# Altium schematic sheet SysUprTestUUUp.SchDoc (part 2 of 2)
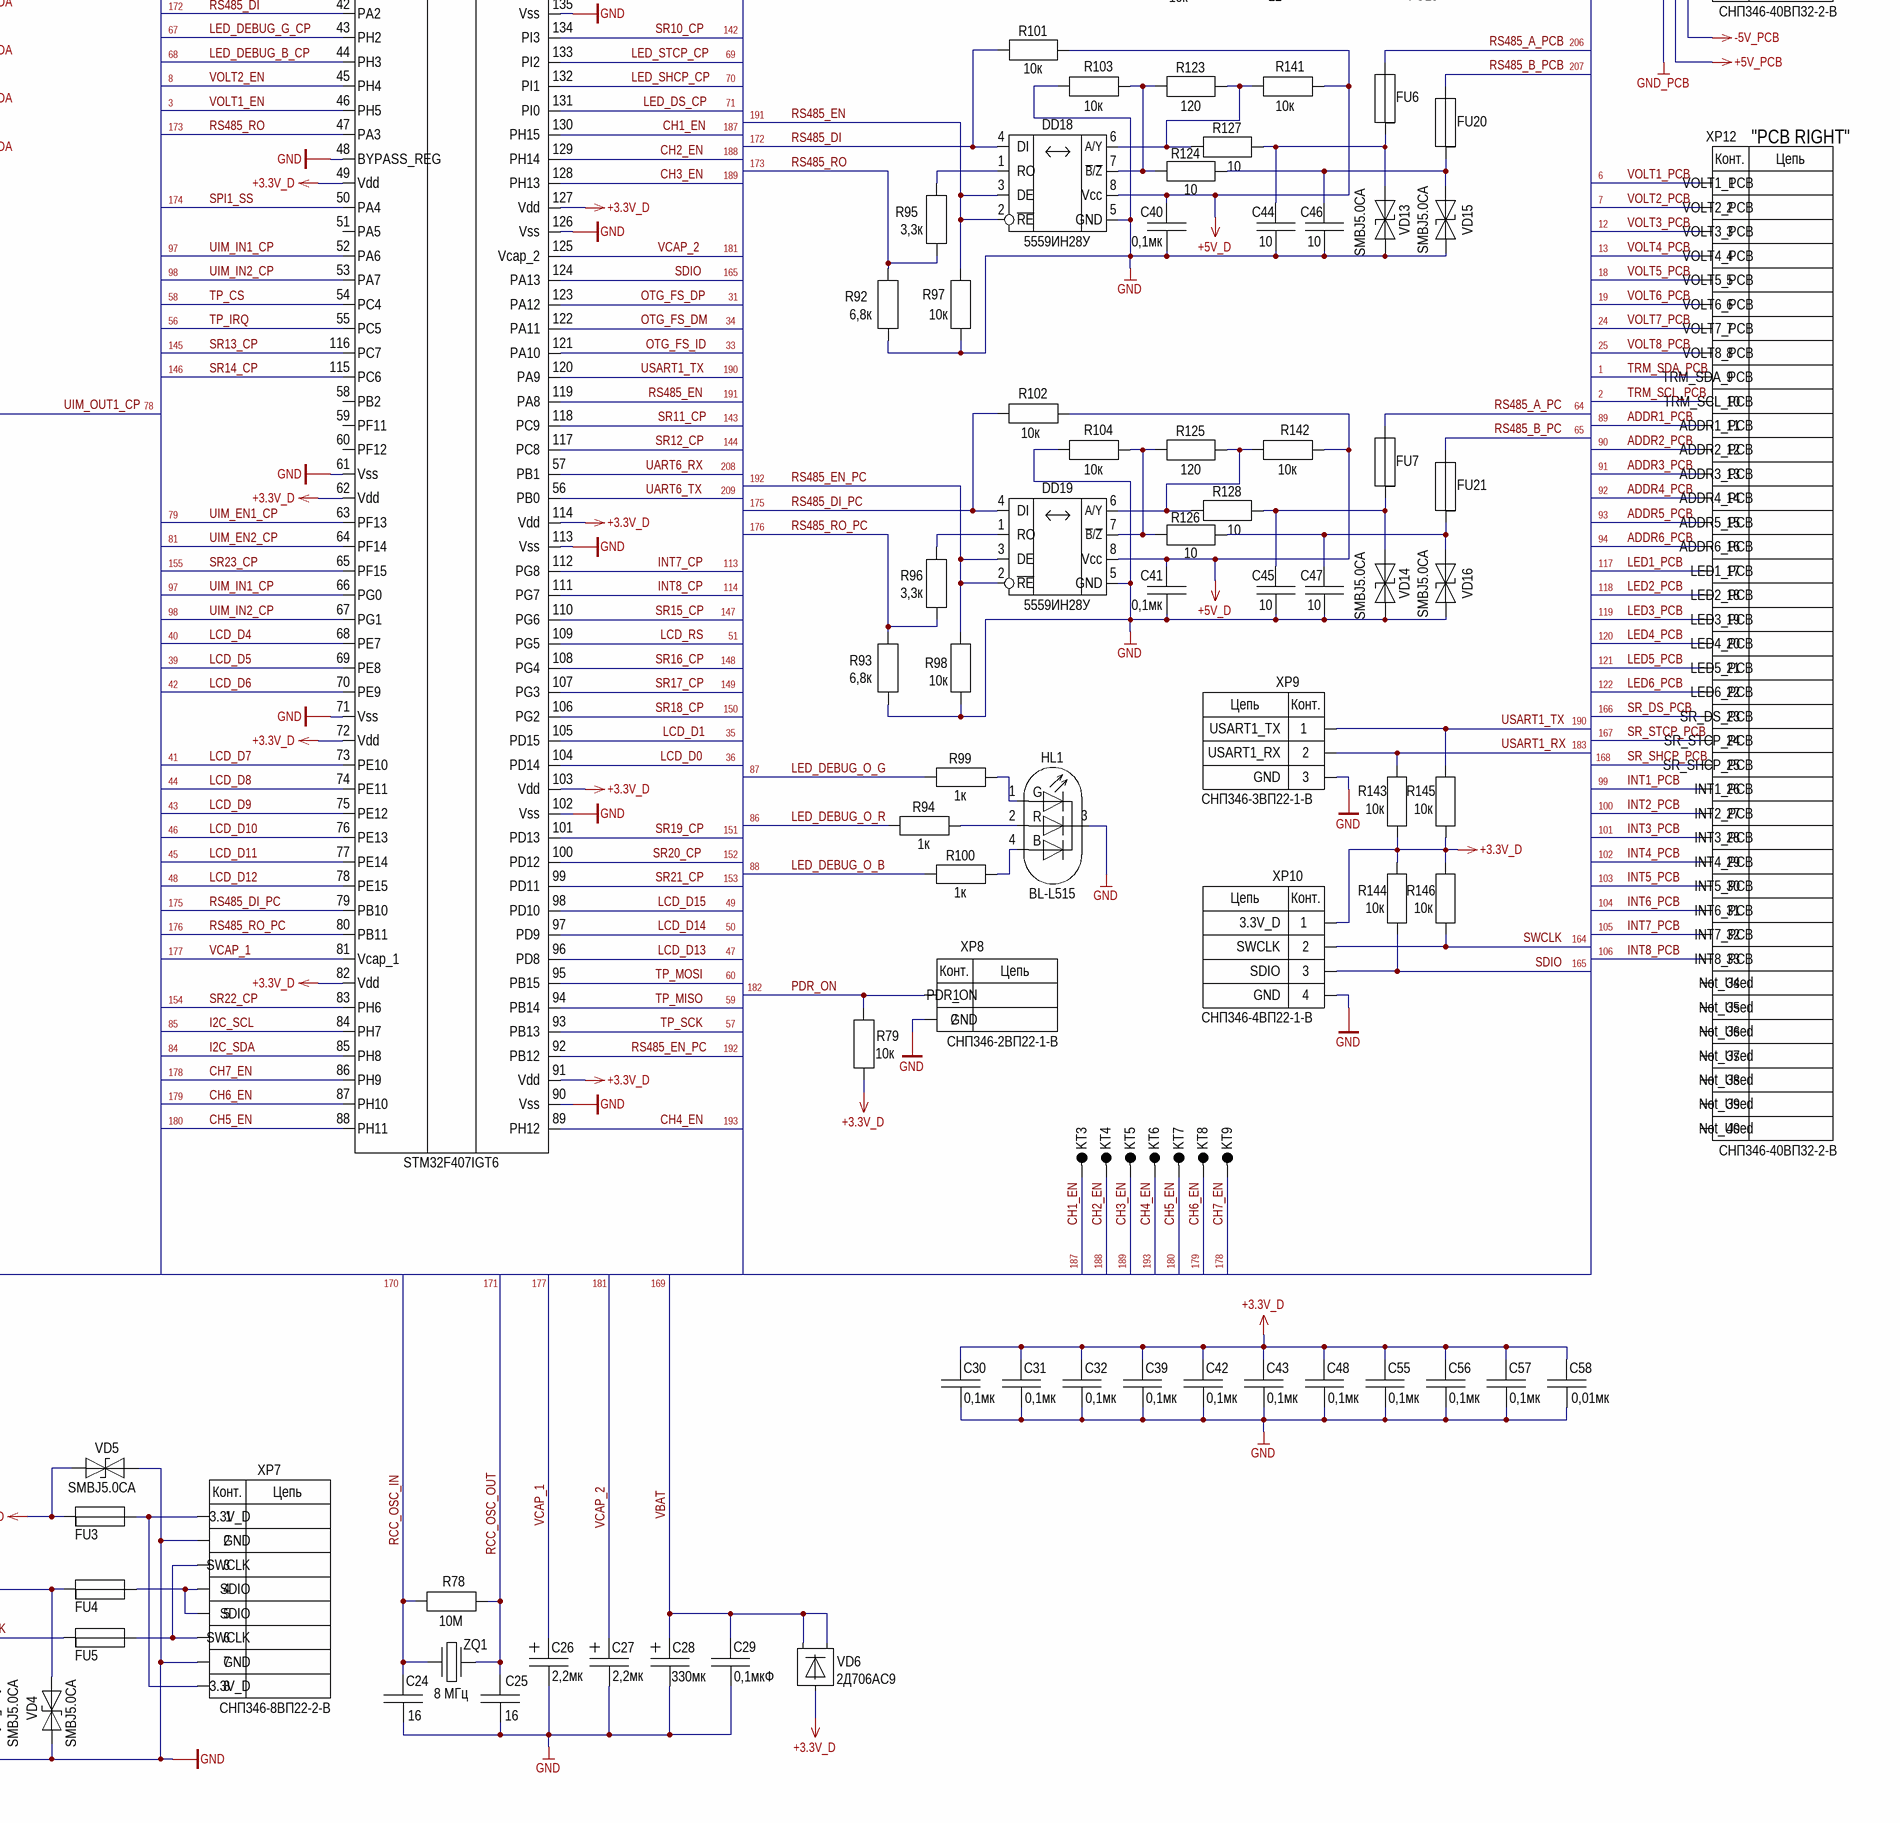
[diagram p4: SysUprTestUUUp.SchDoc, bottom right]

## Library data of the parts
C1 C2 C7 C8 C15 C29 = 2161: PartNumber: К10-84в-2012М-50 В-Н90-0,1 мкФ+80 %-20 %-N-A; Manufacturer: ОАО «ВЗРД Монолит»; ManufacturerTU: ФЦТА.673516.016ТУ; Alternative: 0805 0,1 мкФ, 50 В, ±10 %; Name: К10-84в; Group: Конденсаторы; ViewControl: В, 10%; SolderName: K10-84v-2012M-50V-N90-0,1mkF; X_SORT_1: 100; X_SORT_2: 200; X_SORT_3: 4; SolderTemperature: 175; TemperatureRange: от минус 60 до 85; CardKRR: 67; VoltageLimit: 50; Key: 2161; MilitaryControl: ВП; MountType: ПМ; Modify: 13.03.2019; Package: 0805 (2012); ComponentLink1Description: К10-84; ComponentLink1URL: \\192.168.0.253\U_Base\PDF\C\K10-84.pdf; HelpURL: \\192.168.0.253\U_Base\PDF\C\K10-84.pdf; DataSheet: #\\192.168.0.253\U_Base\PDF\C\K10-84.pdf#
C3 C4 C9 C11 C13 C16 C18 C20 C22 = 2164: PartNumber: К53-56А-16 В-4,7 мкФ±20 %; Manufacturer: АО «НИИ ГИРИКОНД»; ManufacturerTU: АЖЯР.673546.001ТУ; Alternative: Case B 4,7 мкФ, 16 В, ±20 %; Alternative2: К53-56А-16 В-4,7 мкФ±20 % В АДПК.673546.005ТУ; Name: К53-56А; Group: Конденсаторы; ViewControl: В, 10%; SolderName: K53-56A-16V-4.7mkF; X_SORT_1: 100; X_SORT_2: 200; X_SORT_3: 4; SolderTemperature: 265; TemperatureRange: от минус 60 до 125; CardKRR: 67; VoltageLimit: 16; Key: 2164; MilitaryControl: ВП; MountType: ПМ; Modify: 13.03.2019; Package: K2 (Case B); ComponentLink1Description: К53-56А; ComponentLink1URL: \\192.168.0.253\U_Base\PDF\C\K53-56.pdf; HelpURL: \\192.168.0.253\U_Base\PDF\C\K53-56.pdf; DataSheet: #\\192.168.0.253\U_Base\PDF\C\К53-56А.pdf#
C5 C6 C10 C12 C14 C17 C19 C21 C23 C30-C43 C48 C55-C57 = 2161: PartNumber: К10-84в-2012М-50 В-Н90-0,1 мкФ+80 %-20 %-N-A; Manufacturer: ОАО «ВЗРД Монолит»; ManufacturerTU: ФЦТА.673516.016ТУ; Alternative: 0805 0,1 мкФ, 50 В, ±10 %; Name: К10-84в; Group: Конденсаторы; ViewControl: В, 10%; SolderName: K10-84v-2012M-50V-N90-0,1mkF; X_SORT_1: 100; X_SORT_2: 200; X_SORT_3: 4; SolderTemperature: 175; TemperatureRange: от минус 60 до 85; CardKRR: 67; Key: 2161; VoltageLimit: 50; MilitaryControl: ВП; MountType: ПМ; Modify: 13.03.2019; Package: 0805 (2012); ComponentLink1Description: К10-84; ComponentLink1URL: \\192.168.0.253\U_Base\PDF\C\K10-84.pdf; HelpURL: \\192.168.0.253\U_Base\PDF\C\K10-84.pdf; DataSheet: #\\192.168.0.253\U_Base\PDF\C\K10-84.pdf#
C24 C25 = 2141: PartNumber: К10-84в-2012М-100 В-МП0-16 пФ±10 %-N-A; Manufacturer: ОАО «ВЗРД Монолит»; ManufacturerTU: ФЦТА.673516.016ТУ; Alternative: 0805 16 пФ, 100 В, ±10 %; Name: К10-84в; Group: Конденсаторы; ViewControl: В, 10%; SolderName: K10-84v-2012M-100V-MP0-16pF; X_SORT_1: 100; X_SORT_2: 200; X_SORT_3: 4; SolderTemperature: 175; TemperatureRange: от минус 60 до 85; CardKRR: 67; Key: 2141; MilitaryControl: ВП; MountType: ПМ; Modify: 13.03.2019; Package: 0805 (2012); ComponentLink1Description: К10-84; ComponentLink1URL: \\192.168.0.253\U_Base\PDF\C\K10-84.pdf; HelpURL: \\192.168.0.253\U_Base\PDF\C\K10-84.pdf; DataSheet: #\\192.168.0.253\U_Base\PDF\C\K10-84.pdf#; VoltageLimit: 100
C26 C27 = 2166: PartNumber: К53-56А-25 В-2,2 мкФ±20 %; Manufacturer: АО «НИИ ГИРИКОНД»; ManufacturerTU: АЖЯР.673546.001ТУ; Alternative: Case B 2,2 мкФ, 25 В, ±20 %; Alternative2: К53-56А-25 В-2,2 мкФ±20 % В АДПК.673546.005ТУ; Name: К53-56А; Group: Конденсаторы; ViewControl: В, 10%; SolderName: K53-56A-25V-2.2mkF; X_SORT_1: 100; X_SORT_2: 200; X_SORT_3: 4; SolderTemperature: 265; TemperatureRange: от минус 60 до 125; CardKRR: 67; VoltageLimit: 25; Key: 2166; MilitaryControl: ВП; MountType: ПМ; Modify: 13.03.2019; Package: K2 (Case B); ComponentLink1Description: К53-56А; ComponentLink1URL: \\192.168.0.253\U_Base\PDF\C\K53-56.pdf; HelpURL: \\192.168.0.253\U_Base\PDF\C\K53-56.pdf; DataSheet: #\\192.168.0.253\U_Base\PDF\C\К53-56А.pdf#
C28 = 2249: PartNumber: К53-67-10 В-330 мкФ±10 %; Manufacturer: АО «НИИ ГИРИКОНД»; ManufacturerTU: АЖЯР.673546.006ТУ; Alternative: Case D 330 мкФ, 10 В, ±10 %; Name: К53-67; Group: Конденсаторы; ViewControl: В, 10%; SolderName: K53-67-10V-330mkF; X_SORT_1: 100; X_SORT_2: 200; X_SORT_3: 4; SolderTemperature: 265; TemperatureRange: от минус 60 до 125; CardKRR: 67; VoltageLimit: 32; Key: 2249; MilitaryControl: ВП; MountType: ПМ; Modify: 13.03.2019; Package: K3 (Case D); ComponentLink1Description: К53-67
C44-C47 C49-C54 = 2111: PartNumber: К10-84в-1608М-100 В-МП0-10 пФ±10 %-N-A; Manufacturer: ОАО «ВЗРД Монолит»; ManufacturerTU: ФЦТА.673516.016ТУ; Alternative: 0603 10 пФ, 100 В, ±10 %; Name: К10-84в; Group: Конденсаторы; ViewControl: В, 10%; SolderName: K10-84v-1608M-100V-MP0-10pF; X_SORT_1: 100; X_SORT_2: 200; X_SORT_3: 4; SolderTemperature: 175; TemperatureRange: от минус 60 до 85; CardKRR: 67; Key: 2111; MilitaryControl: ВП; MountType: ПМ; Modify: 13.03.2019; Package: 0603 (1608); ComponentLink1Description: К10-84; ComponentLink1URL: \\192.168.0.253\U_Base\PDF\C\K10-84.pdf; HelpURL: \\192.168.0.253\U_Base\PDF\C\K10-84.pdf; DataSheet: #\\192.168.0.253\U_Base\PDF\C\K10-84.pdf#; VoltageLimit: 100
C58 = 2796: PartNumber: К10-69в-Н90-50 В-2012М-0,01 мкФ+80/-20 %-N; Manufacturer: АО "НИИ "ГИРИКОНД"; ManufacturerTU: АЖЯР.673511.002ТУ; Alternative: 0805 0,01 мкФ, 50 В, ±10 %; Name: К10-69в; Group: Конденсаторы; ViewControl: В, 10%; SolderName: K10-69v-N90-50V-2012M-0.01mkF; X_SORT_1: 1; X_SORT_3: 4; TemperatureRange: от минус 60 до 85; CardKRR: 67; Key: 2796; MilitaryControl: ВП; MountType: ПМ; Modify: 03.02.2020; X_SORT_2: 1; ComponentLink1URL: \\192.168.0.253\U_Base\PDF\C\K10-69.pdf; HelpURL: \\192.168.0.253\U_Base\PDF\C\K10-69.pdf; DataSheet: \\192.168.0.253\U_Base\PDF\C\K10-69.pdf
DA1-DA5 = 78: Notice: NXP; Group: Микросхемы; CardKRR: 65; ViewControl: В, 100%; key: 78; TemperatureRange: от минус 55 до 125; X_SORT_1: 200; X_SORT_2: 401; X_SORT_3: 4; Manufacturer: NXP; HelpURL: \\192.168.0.253\U_Base\PDF\D\LM75AD.pdf; Name: LM75AD; MilitaryControl: ОТК; MountType: ПМ; Modify: 15.04.2019; PartNumber: LM75AD; SolderName: LM75AD; ComponentLink1Description: LM75AD; ComponentLink1URL: \\192.168.0.253\U_Base\PDF\D\LM75AD.pdf; DataSheet: #\\192.168.0.253\U_Base\PDF\D\LM75AD.pdf#
DD1 DD2 = 4: Manufacturer: ОАО «ИНТЕГРАЛ»; ManufacturerTU: бК0.347.364-01ТУ; Group: Микросхемы; CardKRR: 65; CurrentLimit: 0,0038; Name: 1533ЛН1; ViewControl: В, 100%; key: 4; TemperatureRange: от минус 60 до 125; X_SORT_1: 200; X_SORT_2: 400; HelpURL: \\192.168.0.101\U_Base\PDF\D\1533ЛН1.pdf; MilitaryControl: ВП; MountType: РМ; Modify: 14.03.2019; PartNumber: 1533ЛН1; SolderName: 1533LN1; Package: 401.14-5; ComponentLink1URL: \\192.168.0.101\U_Base\PDF\D\1533ЛН1.pdf; DataSheet: #\\192.168.0.101\U_Base\PDF\D\1533ЛН1.pdf#; X_SORT_3: 4
DD3-DD7 = 72: Manufacturer: ОАО «ИНТЕГРАЛ»; ManufacturerTU: АЕЯР.431200.182-08ТУ; PartNumber: 1554ЛИ1Т БМ; Group: Микросхемы; Alternative: SNJ54AC08W; CardKRR: 65; CurrentLimit: 0,024; Name: 1554ЛИ1ТБМ; ViewControl: В, 100%; key: 72; SolderName: 1554LI1TBM; TemperatureRange: от минус 60 до 125; X_SORT_1: 200; X_SORT_2: 400; X_SORT_3: 4; HelpURL: \\192.168.0.101\U_Base\PDF\D\1554ЛИ1.pdf; MilitaryControl: ВП; MountType: РМ; Modify: 14.03.2019; Package: 401.14-5; ComponentLink1URL: \\\192.168.0.101\U_Base\PDF\D\1554ЛИ1.pdf; DataSheet: #\\192.168.0.101\U_Base\PDF\D\1554ЛИ1.pdf#; ComponentLink2Description: Аналог 54AC08(W14B); ComponentLink2URL: \\192.168.0.253\U_Base\PDF\D\SN74AC08.pdf
DD8-DD10 = 40: Notice: ONSemiconductor; Group: Микросхемы; CardKRR: 65; Name: 74НС595PW; ViewControl: В, 100%; key: 40; SolderName: 74NS595PW; TemperatureRange: от минус 40 до 125; X_SORT_1: 200; X_SORT_2: 401; X_SORT_3: 4; Manufacturer: ONSemiconductor; HelpURL: \\192.168.0.101\U_Base\PDF\D\74HC595PW.pdf; MilitaryControl: ОТК; MountType: ПМ; Modify: 14.03.2019; PartNumber: 74НС595PW; Package: TSSOP16; ComponentLink1URL: \\192.168.0.101\U_Base\PDF\D\74HC595PW.pdf; DataSheet: #\\192.168.0.101\U_Base\PDF\D\74HC595PW.pdf#
DD11 = 109: Manufacturer: STMicroelectronics; Group: Микросхемы; CardKRR: 64б; ViewControl: В, 100%; X_SORT_1: 201; X_SORT_2: 401; X_SORT_3: 4; TemperatureRange: от минус 40 до 85; key: 109; PartNumber: STM32F407IGT6; HelpURL: \\192.168.0.253\U_Base\PDF\D\STM32F407IGT6 LQFP176.pdf; Name: STM32F407IGT6; MilitaryControl: ОТК; MountType: ПМ; Modify: 15.03.2021; SolderName: STM32F407IGT6; ComponentLink1URL: \\192.168.0.253\U_Base\PDF\D\STM32F407IGT6 LQFP176.pdf; DataSheet: #\\192.168.0.253\U_Base\PDF\D\STM32F407IGT6 LQFP176.pdf#
DD12-DD19 = 70: Manufacturer: АО «ПКК МИЛАНДР»; ManufacturerTU: АЕЯР.431230.882ТУ; Group: Микросхемы; Alternative: К5559ИН28У ТСКЯ.431323.013СП; Alternative2: ADM1485ARZ; Alternative3: LTC1685IS8; CardKRR: 65; CurrentLimit: 0,25; Name: 5559ИН28У; ViewControl: В, 100%; key: 70; SolderName: 5559IN28U; Mark: ИН28; TemperatureRange: от минус 60 до 125; X_SORT_1: 200; X_SORT_2: 400; X_SORT_3: 4; HelpURL: \\192.168.0.101\U_Base\PDF\D\5559ИН28У.pdf; MilitaryControl: ВП; MountType: РМ; Modify: 14.03.2019; PartNumber: 5559ИН28У; Package: H02.8-1B; ComponentLink1URL: \\192.168.0.101\U_Base\PDF\D\5559ИН28У.pdf; DataSheet: #\\192.168.0.101\U_Base\PDF\D\5559ИН28У.pdf#
FU1 FU2 FU6-FU21 = 72: Manufacturer: Bourns; PartNumber: Предохранитель самовосстанавливающийся MF-MSMF020, 0.2 A; Name: MF-MSMF020, 0.2 A; Group: Предохранитель; ViewControl: В,100%; Key: 72; SolderName: MF-MSMF020,0.2 A; Mass: 0,1; TemperatureRange: от минус 40 до 85; CardKRR: 87; X_SORT_3: 4; MilitaryControl: ОТК; MountType: РМ; Modify: 05.12.2022; ComponentLink1URL: \\192.168.0.101\U_Base\PDF\OTHER\MF-MSMFxxx.pdf; HelpURL: \\192.168.0.101\U_Base\PDF\OTHER\MF-MSMFxxx.pdf; DataSheet: #\\192.168.0.101\U_Base\PDF\OTHER\MF-MSMFxxx.pdf#
FU3-FU5 = 74: Manufacturer: Bourns; PartNumber: Предохранитель самовосстанавливающийся MF-MSMF050, 0.5 A; Name: MF-MSMF050, 0.5 A; Group: Предохранитель; ViewControl: В,100%; Key: 74; SolderName: MF-MSMF050,0.5 A; Mass: 0,1; TemperatureRange: от минус 40 до 85; CardKRR: 87; X_SORT_3: 4; MilitaryControl: ОТК; MountType: РМ; Modify: 05.12.2022; ComponentLink1URL: \\192.168.0.101\U_Base\PDF\OTHER\MF-MSMFxxx.pdf; HelpURL: \\192.168.0.101\U_Base\PDF\OTHER\MF-MSMFxxx.pdf; DataSheet: #\\192.168.0.101\U_Base\PDF\OTHER\MF-MSMFxxx.pdf#
HL1 = 90: Светодиод RGB с общим анодом BL-L515RGBW-CA; PartNumber: Светодиод BL-L515RGBW-CС; Notice: Betlux Electronics; Group: Светодиоды; ViewControl: В, 10%; key: 90; X_SORT_1: 500; X_SORT_2: 301; X_SORT_3: 4; Name: BL-L515; Modify: 14.03.2019; Manufacturer: Betlux Electronics; MilitaryControl: ОТК; MountType: РМ; SolderName: BL-L515; Package: 6mm; ComponentLink1Description: BL-L515; ComponentLink1URL: \\192.168.0.101\U_Base\PDF\V\BetLux Electronics.pdf; HelpURL: \\192.168.0.101\U_Base\PDF\V\BetLux Electronics.pdf; DataSheet: #\\192.168.0.101\U_Base\PDF\V\BetLux Electronics.pdf#
KT1-KT9 = 4: PartNumber: Контакт; SolderName: Kontakt; Key: 4; X_SORT_3: 4
R1-R6 R22-R27 R38-R40 R94 R99 R100 = 2901: Manufacturer: АО «НПО «Эркон»; ManufacturerTU: ОЖ0.467.164ТУ; PartNumber: Р1-8В-0,063-1 кОм±5 %-Т-А; Alternative: 0402 1 кОм, 0,062 Вт, ±5 %; Alternative2: Р1-8В-0,062-1 кОм±5 %-Т-А ОЖ0.467.164ТУ; Name: Р1-8В; Group: Резисторы; ViewControl: В, 10%; key: 2901; SolderName: R1-8B-0.063-1kOm; Mark: 102; Mass: 0,0007; SolderTemperature: 255; TemperatureRange: от минус 65 до 155; CardKRR: 68; VoltageLimit: 50; PowerLimit: 0,063; X_SORT_1: 400; X_SORT_2: 100; X_SORT_3: 4; Modify: 28.06.2019; MilitaryControl: ВП; MountType: ПМ; Package: 0402 (1005); ComponentLink1Description: Р1-8В; ComponentLink1URL: \\192.168.0.101\U_Base\PDF\R\Р1-8В.pdf; HelpURL: \\192.168.0.101\U_Base\PDF\R\Р1-8В.pdf; DataSheet: #\\192.168.0.101\U_Base\PDF\R\Р1-8В.pdf#
R7-R19 R28 R29 R49 R50 R67-R77 R79-R91 R97 R98 R102-R110 R117-R122 R141-R146 = 2905: PartNumber: Р1-8В-0,063-10 кОм±5 %-Т-А; Manufacturer: АО «НПО «Эркон»; ManufacturerTU: ОЖ0.467.164ТУ; Alternative: 0402 10 кОм, 0,062 Вт, ±5 %; Alternative2: Р1-8В-0,062-10 кОм±5 %-Т-А ОЖ0.467.164ТУ; Name: Р1-8В; Group: Резисторы; ViewControl: В, 10%; SolderName: R1-8B-0.063-10kOm; Mark: 103; X_SORT_1: 400; X_SORT_2: 100; X_SORT_3: 4; Mass: 0,0007; SolderTemperature: 255; TemperatureRange: от минус 65 до 155; CardKRR: 68; VoltageLimit: 50; PowerLimit: 0,063; key: 2905; Modify: 28.06.2019; MilitaryControl: ВП; MountType: ПМ; Package: 0402 (1005); ComponentLink1Description: Р1-8В; ComponentLink1URL: \\192.168.0.253\U_Base\PDF\R\Р1-8В.pdf; HelpURL: \\192.168.0.253\U_Base\PDF\R\Р1-8В.pdf; DataSheet: #\\192.168.0.253\U_Base\PDF\R\Р1-8В.pdf#
R20 R21 R30-R37 R41-R48 R51-R58 = 2907: Manufacturer: АО «НПО «Эркон»; ManufacturerTU: ОЖ0.467.164ТУ; PartNumber: Р1-8В-0,063-100 кОм±5 %-Т-А; Alternative: 0402 100 кОм, 0,062 Вт, ±5 %; Alternative2: Р1-8В-0,062-100 кОм±5 %-Т-А ОЖ0.467.164ТУ; Name: Р1-8В; Group: Резисторы; ViewControl: В, 10%; key: 2907; SolderName: R1-8B-0.063-100kOm; Mark: 104; Mass: 0,0007; SolderTemperature: 255; TemperatureRange: от минус 65 до 155; CardKRR: 68; VoltageLimit: 50; PowerLimit: 0,063; X_SORT_1: 400; X_SORT_2: 100; X_SORT_3: 4; Modify: 28.06.2019; MilitaryControl: ВП; MountType: ПМ; Package: 0402 (1005); ComponentLink1Description: Р1-8В; ComponentLink1URL: \\192.168.0.101\U_Base\PDF\R\Р1-8В.pdf; HelpURL: \\192.168.0.101\U_Base\PDF\R\Р1-8В.pdf; DataSheet: #\\192.168.0.101\U_Base\PDF\R\Р1-8В.pdf#
R59-R66 R111-R116 R123 R125 = 32904934: Manufacturer: АО «НПО «Эркон»; ManufacturerTU: ОЖ0.467.164ТУ; PartNumber: Р1-8В-0,125-120 Ом±5 %-Т-А; Alternative: 0805 120 Ом, 0,125 Вт, ±5 %; Alternative2: Р1-8В-0,125-120 Ом±5 %-Т-А ОЖ0.467.164ТУ; Name: Р1-8В; Group: Резисторы; ViewControl: В, 10%; SolderName: R1-8B-0.125-120Om; Mark: 121; Mass: 0,006; SolderTemperature: 255; TemperatureRange: от минус 65 до 155; CardKRR: 68; VoltageLimit: 150; PowerLimit: 0,125; X_SORT_1: 400; X_SORT_2: 100; X_SORT_3: 4; Modify: 24.10.2022; MilitaryControl: ВП; MountType: ПМ; key: 32904934; Package: 0805 (2012); ComponentLink1Description: Р1-8В; ComponentLink1URL: \\192.168.0.101\U_Base\PDF\R\Р1-8В.pdf; HelpURL: \\192.168.0.101\U_Base\PDF\R\Р1-8В.pdf; DataSheet: #\\192.168.0.101\U_Base\PDF\R\Р1-8В.pdf#
R78 = 32904893: PartNumber: Р1-8В-0,125-10 МОм±5 %-Т-А; Manufacturer: АО «НПО «Эркон»; ManufacturerTU: ОЖ0.467.164ТУ; Alternative: 0805 10 МОм, 0,125 Вт, ±5 %; Name: Р1-8В; Group: Резисторы; ViewControl: В, 10%; SolderName: R1-8B-0.125-10MOm; X_SORT_1: 400; X_SORT_2: 100; X_SORT_3: 4; SolderTemperature: 255; TemperatureRange: от минус 65 до 155; CardKRR: 68; VoltageLimit: 150; PowerLimit: 0,125; Modify: 28.06.2019; MilitaryControl: ВП; MountType: ПМ; ComponentLink1Description: Р1-8В; ComponentLink1URL: \\192.168.0.253\U_Base\PDF\R\Р1-8В.pdf; HelpURL: \\192.168.0.253\U_Base\PDF\R\Р1-8В.pdf; DataSheet: \\192.168.0.253\U_Base\PDF\R\Р1-8В.pdf; key: 32904893
R92 R93 = 2933: Manufacturer: АО «НПО «Эркон»; ManufacturerTU: ОЖ0.467.164ТУ; PartNumber: Р1-8В-0,063-6,8 кОм±5 %-Т-А; Alternative: 0402 6,8 кОм, 0,062 Вт, ±5 %; Alternative2: Р1-8В-0,062-6,8 кОм±5 %-Т-А ОЖ0.467.164ТУ; Name: Р1-8В; Group: Резисторы; ViewControl: В, 10%; key: 2933; SolderName: R1-8B-0.063-6.8kOm; Mark: 682; Mass: 0,0007; SolderTemperature: 255; TemperatureRange: от минус 65 до 155; CardKRR: 68; VoltageLimit: 50; PowerLimit: 0,063; X_SORT_1: 400; X_SORT_2: 100; X_SORT_3: 4; Modify: 28.06.2019; MilitaryControl: ВП; MountType: ПМ; Package: 0402 (1005); ComponentLink1Description: Р1-8В; ComponentLink1URL: \\192.168.0.101\U_Base\PDF\R\Р1-8В.pdf; HelpURL: \\192.168.0.101\U_Base\PDF\R\Р1-8В.pdf; DataSheet: #\\192.168.0.101\U_Base\PDF\R\Р1-8В.pdf#
R95 R96 = 2920: Manufacturer: АО «НПО «Эркон»; ManufacturerTU: ОЖ0.467.164ТУ; PartNumber: Р1-8В-0,063-3,3 кОм±5 %-Т-А; Alternative: 0402 3,3 кОм, 0,062 Вт, ±5 %; Alternative2: Р1-8В-0,062-3,3 кОм±5 %-Т-А ОЖ0.467.164ТУ; Name: Р1-8В; Group: Резисторы; ViewControl: В, 10%; key: 2920; SolderName: R1-8B-0.063-3.3kOm; Mark: 332; Mass: 0,0007; SolderTemperature: 255; TemperatureRange: от минус 65 до 155; CardKRR: 68; VoltageLimit: 50; PowerLimit: 0,063; X_SORT_1: 400; X_SORT_2: 100; X_SORT_3: 4; Modify: 28.06.2019; MilitaryControl: ВП; MountType: ПМ; Package: 0402 (1005); ComponentLink1Description: Р1-8В; ComponentLink1URL: \\192.168.0.101\U_Base\PDF\R\Р1-8В.pdf; HelpURL: \\192.168.0.101\U_Base\PDF\R\Р1-8В.pdf; DataSheet: #\\192.168.0.101\U_Base\PDF\R\Р1-8В.pdf#
R101 = 2943: Manufacturer: АО «НПО «Эркон»; ManufacturerTU: ОЖ0.467.164ТУ; PartNumber: Р1-8В-0,1-10 кОм±5 %-Т-А; Alternative: 0603 10 кОм, 0,1 Вт, ±5 %; Alternative2: Р1-8В-0,1-10 кОм±5 %-Т-А ОЖ0.467.164ТУ; Name: Р1-8В; Group: Резисторы; ViewControl: В, 10%; key: 2943; SolderName: R1-8B-0.1-10kOm; Mark: 103; Mass: 0,002; SolderTemperature: 255; TemperatureRange: от минус 65 до 155; CardKRR: 68; VoltageLimit: 100; PowerLimit: 0,1; X_SORT_1: 400; X_SORT_3: 4; Modify: 28.06.2019; MilitaryControl: ВП; MountType: ПМ; Package: 0603 (1608); ComponentLink1Description: Р1-8В; ComponentLink1URL: \\192.168.0.253\U_Base\PDF\R\Р1-8В.pdf; HelpURL: \\192.168.0.253\U_Base\PDF\R\Р1-8В.pdf; DataSheet: \\192.168.0.253\U_Base\PDF\R\Р1-8В.pdf; X_SORT_2: 100
R124 R126-R128 = 2944: Manufacturer: АО «НПО «Эркон»; ManufacturerTU: ОЖ0.467.164ТУ; PartNumber: Р1-8В-0,1-10 Ом±5 %-Т-А; Alternative: 0603 10 Ом, 0,1 Вт, ±5 %; Alternative2: Р1-8В-0,1-10 Ом±5 %-Т-А ОЖ0.467.164ТУ; Name: Р1-8В; Group: Резисторы; ViewControl: В, 10%; key: 2944; SolderName: R1-8B-0.1-10Om; Mark: 100; Mass: 0,002; SolderTemperature: 255; TemperatureRange: от минус 65 до 155; CardKRR: 68; PowerLimit: 0,1; X_SORT_1: 400; X_SORT_3: 4; Modify: 28.06.2019; MilitaryControl: ВП; MountType: ПМ; Package: 0603 (1608); ComponentLink1Description: Р1-8В; ComponentLink1URL: \\192.168.0.253\U_Base\PDF\R\Р1-8В.pdf; HelpURL: \\192.168.0.253\U_Base\PDF\R\Р1-8В.pdf; DataSheet: \\192.168.0.253\U_Base\PDF\R\Р1-8В.pdf; VoltageLimit: 100; X_SORT_2: 100
R129-R140 = 2977: Manufacturer: АО «НПО «Эркон»; ManufacturerTU: ОЖ0.467.164ТУ; PartNumber: Р1-8В-0,125-22 Ом±5 %-Т-А; Alternative: 0805 22 Ом, 0,125 Вт, ±5 %; Alternative2: Р1-8В-0,125-22 Ом±5 %-Т-А ОЖ0.467.164ТУ; Name: Р1-8В; Group: Резисторы; ViewControl: В, 10%; key: 2977; SolderName: R1-8B-0.125-22Om; Mark: 220; Mass: 0,006; SolderTemperature: 255; TemperatureRange: от минус 65 до 155; CardKRR: 68; VoltageLimit: 150; PowerLimit: 0,125; X_SORT_1: 400; X_SORT_2: 100; X_SORT_3: 4; Modify: 28.06.2019; MilitaryControl: ВП; MountType: ПМ; Package: 0805 (2012); ComponentLink1Description: Р1-8В; ComponentLink1URL: \\192.168.0.101\U_Base\PDF\R\Р1-8В.pdf; HelpURL: \\192.168.0.101\U_Base\PDF\R\Р1-8В.pdf; DataSheet: #\\192.168.0.101\U_Base\PDF\R\Р1-8В.pdf#
VD1-VD5 VD13-VD16 = 163: Manufacturer: STMicroelectronics; PartNumber: Диод защитный SMBJ5.0CA-TR; Alternative: SMBJ5.0CA-TR YJ; Value: SMBJ5.0CA; Group: Диоды; ViewControl: В, 10%; key: 163; Mass: 0.26; SolderTemperature: 260; TemperatureRange: от минус 55 до 150; CardKRR: 56; VoltageLimit: 13,4; X_SORT_3: 4; Modify: 05.12.2022; MilitaryControl: ОТК; MountType: ПМ; SolderName: SMBJ5.0CA; ComponentLink1URL: \\192.168.0.101\U_Base\PDF\V\SMBJ.pdf; HelpURL: \\192.168.0.101\U_Base\PDF\V\SMBJ.pdf; DataSheet: #\\192.168.0.101\U_Base\PDF\V\SMBJ.pdf#
VD6 = 15: PartNumber: Набор диодов 2Д706АС9; Manufacturer: ООО «Крип Техно»; ManufacturerTU: аА0.339.582ТУ; Alternative: КД706АС9 аА0.336.543ТУ; Alternative2: BAW56LT1G; Group: Диоды; ViewControl: В, 10%; key: 15; SolderName: 2D706AS9; X_SORT_1: 500; X_SORT_2: 300; X_SORT_3: 4; Mass: 0,009; TemperatureRange: от минус 60 до 125; CardKRR: 55; Modify: 14.03.2019; MilitaryControl: ВП; MountType: ПМ; Package: SOT23; ComponentLink1Description: 2Д706АС9; ComponentLink1URL: \\192.168.0.253\U_Base\PDF\V\2Д706АС9.pdf; HelpURL: \\192.168.0.253\U_Base\PDF\V\2Д706АС9.pdf; DataSheet: #\\192.168.0.253\U_Base\PDF\V\2Д706АС9.pdf#
VD7-VD12 = 164: Manufacturer: STMicroelectronics; PartNumber: Диод защитный SMBJ12.0CA-TR; Alternative: SMBJ12.0CA-TR YJ; Value: SMBJ12.0CA; Group: Диоды; ViewControl: В, 10%; key: 164; Mass: 0.26; SolderTemperature: 260; TemperatureRange: от минус 55 до 150; CardKRR: 56; VoltageLimit: 13,4; X_SORT_3: 4; Modify: 05.12.2022; MilitaryControl: ОТК; MountType: ПМ; SolderName: SMBJ12.0CA; ComponentLink1URL: \\192.168.0.101\U_Base\PDF\V\SMBJ.pdf; HelpURL: \\192.168.0.101\U_Base\PDF\V\SMBJ.pdf; DataSheet: #\\192.168.0.101\U_Base\PDF\V\SMBJ.pdf#
XP1 = 57: Manufacturer: АО «Карачевский завод Электродеталь»; ManufacturerTU: РЮМК.430420.011ТУ; PartNumber: Вилка СНП346-34ВП22-2-В; Conn35Name: 35; Conn36Name: 36; Conn37Name: 37; Conn38Name: 38; Conn39Name: 39; Conn40Name: 40; Conn01Name: GND; Conn02Name: 5V; Conn03Name: D1; Conn04Name: D0; Conn05Name: D3; Conn06Name: D2; Conn07Name: D5; Conn08Name: D4; Conn09Name: D7; Conn10Name: D6; Conn11Name: D9; Conn12Name: D8; Conn13Name: D11; Conn14Name: D10; Conn15Name: D13; Conn16Name: D12; Conn17Name: D15; Conn18Name: D14; Conn19Name: RS; Conn21Name: RD; Conn22Name: WR; Conn20Name: LCD-CS; Conn23Name: NC; Conn24Name: RST; Conn26Name: BL-VCC; Conn27Name: TP-IRQ; Conn28Name: BL-CTRL; Conn29Name: TP-SCK; Conn30Name: TP-CS; Conn31Name: TP-SDO; Conn32Name: TP-SDI; Conn34Name: 3V3; Alternative2: СНП346-34ВП22-2 РЮМК.430420.019ТУ; Name: СНП346-34ВП22-2-В; Value: 34; Group: Соединители; ViewControl: В, 10%; key: 57; SolderName: SNP346-34VP22-2; Mass: 0,00204; TemperatureRange: от минус 60 до 85; CardKRR: 75; VoltageLimit: 250; CurrentLimit: 1; X_SORT_1: 700; X_SORT_2: 600; X_SORT_3: 4; Conn25Name: GND; Conn33Name: GND; Alternative: PLD-34; MilitaryControl: ВП; MountType: РМ; Modify: 19.09.2018; Package: PLD; ComponentLink1Description: СНП346; ComponentLink1URL: \\192.168.0.101\U_Base\PDF\X\СНП346.pdf; HelpURL: \\192.168.0.101\U_Base\PDF\X\СНП346.pdf; DataSheet: #\\192.168.0.101\U_Base\PDF\X\СНП346.pdf#; PowerLimit: 250
XP2 = 45: Manufacturer: АО «Карачевский завод Электродеталь»; ManufacturerTU: РЮМК.430420.011ТУ; PartNumber: Вилка СНП346-10ВП22-2-В; Conn11Name: 11; Conn12Name: 12; Conn13Name: 13; Conn14Name: 14; Conn15Name: 15; Conn16Name: 16; Conn17Name: 17; Conn18Name: 18; Conn19Name: 19; Conn20Name: 20; Conn21Name: 21; Conn22Name: 22; Conn23Name: 23; Conn24Name: 24; Conn25Name: 25; Conn26Name: 26; Conn27Name: 27; Conn28Name: 28; Conn29Name: 29; Conn30Name: 30; Conn31Name: 31; Conn32Name: 32; Conn33Name: 33; Conn34Name: 34; Conn35Name: 35; Conn36Name: 36; Conn37Name: 37; Conn38Name: 38; Conn39Name: 39; Conn40Name: 40; Conn01Name: LED_STCP; Conn02Name: LED_SHCP; Conn03Name: LED_DS; Conn04Name: +5V; Conn05Name: GND; Alternative2: СНП346-10ВП22-2 РЮМК.430420.019ТУ; Name: СНП346-10ВП22-2-В; Value: 10; Group: Соединители; ViewControl: В, 10%; key: 45; SolderName: SNP346-10VP22-2; Mass: 0,0006; TemperatureRange: от минус 60 до 85; CardKRR: 75; VoltageLimit: 250; CurrentLimit: 1; X_SORT_1: 700; X_SORT_2: 600; X_SORT_3: 4; Conn06Name: GND; Conn07Name: +5V; Conn08Name: LED_DS; Conn09Name: LED_SHCP; Conn10Name: LED_STCP; Alternative: PLD-10; MilitaryControl: ВП; MountType: РМ; Modify: 19.09.2018; Package: PLD; ComponentLink1Description: СНП346; ComponentLink1URL: \\192.168.0.101\U_Base\PDF\X\СНП346.pdf; HelpURL: \\192.168.0.101\U_Base\PDF\X\СНП346.pdf; DataSheet: #\\192.168.0.101\U_Base\PDF\X\СНП346.pdf#; PowerLimit: 250
XP3 = 42: Manufacturer: АО «Карачевский завод Электродеталь»; ManufacturerTU: РЮМК.430420.011ТУ; PartNumber: Вилка СНП346-4ВП22-2-В; Conn05Name: 5; Conn06Name: 6; Conn07Name: 7; Conn08Name: 8; Conn09Name: 9; Conn10Name: 10; Conn11Name: 11; Conn12Name: 12; Conn13Name: 13; Conn14Name: 14; Conn15Name: 15; Conn16Name: 16; Conn17Name: 17; Conn18Name: 18; Conn19Name: 19; Conn20Name: 20; Conn21Name: 21; Conn22Name: 22; Conn23Name: 23; Conn24Name: 24; Conn25Name: 25; Conn26Name: 26; Conn27Name: 27; Conn28Name: 28; Conn29Name: 29; Conn30Name: 30; Conn31Name: 31; Conn32Name: 32; Conn33Name: 33; Conn34Name: 34; Conn35Name: 35; Conn36Name: 36; Conn37Name: 37; Conn38Name: 38; Conn39Name: 39; Conn40Name: 40; Conn02Name: RS485_B_PC; Conn04Name: RS485_A_PC; Alternative2: СНП346-4ВП22-2 РЮМК.430420.019ТУ; Name: СНП346-4ВП22-2-В; Value: 4; Group: Соединители; ViewControl: В, 10%; key: 42; SolderName: SNP346-4VP22-2; Mass: 0,00024; TemperatureRange: от минус 60 до 85; CardKRR: 75; VoltageLimit: 250; CurrentLimit: 1; X_SORT_1: 700; X_SORT_2: 600; Conn03Name: RS485_B_PC; Conn01Name: RS485_A_PC; Alternative: PLD-4; MilitaryControl: ВП; MountType: РМ; Modify: 19.09.2018; Package: PLD; ComponentLink1Description: СНП346; ComponentLink1URL: \\192.168.0.101\U_Base\PDF\X\СНП346.pdf; HelpURL: \\192.168.0.101\U_Base\PDF\X\СНП346.pdf; DataSheet: #\\192.168.0.101\U_Base\PDF\X\СНП346.pdf#; PowerLimit: 250; X_SORT_3: 4
XP4 = 44: Manufacturer: АО «Карачевский завод Электродеталь»; ManufacturerTU: РЮМК.430420.011ТУ; PartNumber: Вилка СНП346-8ВП22-2-В; Conn09Name: 9; Conn10Name: 10; Conn11Name: 11; Conn12Name: 12; Conn13Name: 13; Conn14Name: 14; Conn15Name: 15; Conn16Name: 16; Conn17Name: 17; Conn18Name: 18; Conn19Name: 19; Conn20Name: 20; Conn21Name: 21; Conn22Name: 22; Conn23Name: 23; Conn24Name: 24; Conn25Name: 25; Conn26Name: 26; Conn27Name: 27; Conn28Name: 28; Conn29Name: 29; Conn30Name: 30; Conn31Name: 31; Conn32Name: 32; Conn33Name: 33; Conn34Name: 34; Conn35Name: 35; Conn36Name: 36; Conn37Name: 37; Conn38Name: 38; Conn39Name: 39; Conn40Name: 40; Conn08Name: +48; Conn07Name: GND; Alternative2: СНП346-8ВП22-2 РЮМК.430420.019ТУ; Name: СНП346-8ВП22-2-В; Value: 8; Group: Соединители; ViewControl: В, 10%; key: 44; SolderName: SNP346-8VP22-2; Mass: 0,00048; TemperatureRange: от минус 60 до 85; CardKRR: 75; VoltageLimit: 250; CurrentLimit: 1; X_SORT_1: 700; X_SORT_2: 600; X_SORT_3: 4; Conn06Name: GND; Conn05Name: +48; Conn04Name: +48; Conn03Name: GND; Conn02Name: GND; Conn01Name: +48; Alternative: PLD-8; MilitaryControl: ВП; MountType: РМ; Modify: 19.09.2018; Package: PLD; ComponentLink1Description: СНП346; ComponentLink1URL: \\192.168.0.101\U_Base\PDF\X\СНП346.pdf; HelpURL: \\192.168.0.101\U_Base\PDF\X\СНП346.pdf; DataSheet: #\\192.168.0.101\U_Base\PDF\X\СНП346.pdf#; PowerLimit: 250
XP5 = 2: PartNumber: Вилка СНП346-2ВП22-1-В; Manufacturer: АО «Карачевский завод Электродеталь»; ManufacturerTU: РЮМК.430420.011ТУ; Conn01Name: BOOT0; Conn02Name: GND; Conn03Name: 3; Conn04Name: 4; Conn05Name: 5; Conn06Name: 6; Conn07Name: 7; Conn08Name: 8; Conn09Name: 9; Conn10Name: 10; Conn11Name: 11; Conn12Name: 12; Conn13Name: 13; Conn14Name: 14; Conn15Name: 15; Conn16Name: 16; Conn17Name: 17; Conn18Name: 18; Conn19Name: 19; Conn20Name: 20; Conn21Name: 21; Conn22Name: 22; Conn23Name: 23; Conn24Name: 24; Conn25Name: 25; Conn26Name: 26; Conn27Name: 27; Conn28Name: 28; Conn29Name: 29; Conn30Name: 30; Conn31Name: 31; Conn32Name: 32; Conn33Name: 33; Conn34Name: 34; Conn35Name: 35; Conn36Name: 36; Conn37Name: 37; Conn38Name: 38; Conn39Name: 39; Conn40Name: 40; Alternative2: СНП346-2ВП22-1 РЮМК.430420.019ТУ; Name: СНП346-2ВП22-1-В; Value: 2; Group: Соединители; ViewControl: В, 10%; SolderName: SNP346-2VP22-1; X_SORT_1: 700; X_SORT_2: 600; Mass: 0,00012; TemperatureRange: от минус 60 до 85; CardKRR: 75; VoltageLimit: 250; CurrentLimit: 1; Alternative: PLS-2; MilitaryControl: ВП; MountType: РМ; Modify: 19.09.2018; X_SORT_3: 4; Package: PLS; ComponentLink1Description: СНП346; ComponentLink1URL: \\192.168.0.253\U_Base\PDF\X\СНП346.pdf; HelpURL: \\192.168.0.253\U_Base\PDF\X\СНП346.pdf; DataSheet: #\\192.168.0.253\U_Base\PDF\X\СНП346.pdf#; PowerLimit: 250; key: 2
XP6 = 2: PartNumber: Вилка СНП346-2ВП22-1-В; Manufacturer: АО «Карачевский завод Электродеталь»; ManufacturerTU: РЮМК.430420.011ТУ; Conn01Name: NRST; Conn02Name: GND; Conn03Name: 3; Conn04Name: 4; Conn05Name: 5; Conn06Name: 6; Conn07Name: 7; Conn08Name: 8; Conn09Name: 9; Conn10Name: 10; Conn11Name: 11; Conn12Name: 12; Conn13Name: 13; Conn14Name: 14; Conn15Name: 15; Conn16Name: 16; Conn17Name: 17; Conn18Name: 18; Conn19Name: 19; Conn20Name: 20; Conn21Name: 21; Conn22Name: 22; Conn23Name: 23; Conn24Name: 24; Conn25Name: 25; Conn26Name: 26; Conn27Name: 27; Conn28Name: 28; Conn29Name: 29; Conn30Name: 30; Conn31Name: 31; Conn32Name: 32; Conn33Name: 33; Conn34Name: 34; Conn35Name: 35; Conn36Name: 36; Conn37Name: 37; Conn38Name: 38; Conn39Name: 39; Conn40Name: 40; Alternative2: СНП346-2ВП22-1 РЮМК.430420.019ТУ; Name: СНП346-2ВП22-1-В; Value: 2; Group: Соединители; ViewControl: В, 10%; SolderName: SNP346-2VP22-1; X_SORT_1: 700; X_SORT_2: 600; Mass: 0,00012; TemperatureRange: от минус 60 до 85; CardKRR: 75; VoltageLimit: 250; CurrentLimit: 1; Alternative: PLS-2; MilitaryControl: ВП; MountType: РМ; Modify: 19.09.2018; X_SORT_3: 4; Package: PLS; ComponentLink1Description: СНП346; ComponentLink1URL: \\192.168.0.253\U_Base\PDF\X\СНП346.pdf; HelpURL: \\192.168.0.253\U_Base\PDF\X\СНП346.pdf; DataSheet: #\\192.168.0.253\U_Base\PDF\X\СНП346.pdf#; PowerLimit: 250; key: 2
XP7 = 44: Manufacturer: АО «Карачевский завод Электродеталь»; ManufacturerTU: РЮМК.430420.011ТУ; PartNumber: Вилка СНП346-8ВП22-2-В; Conn09Name: 9; Conn10Name: 10; Conn11Name: 11; Conn12Name: 12; Conn13Name: 13; Conn14Name: 14; Conn15Name: 15; Conn16Name: 16; Conn17Name: 17; Conn18Name: 18; Conn19Name: 19; Conn20Name: 20; Conn21Name: 21; Conn22Name: 22; Conn23Name: 23; Conn24Name: 24; Conn25Name: 25; Conn26Name: 26; Conn27Name: 27; Conn28Name: 28; Conn29Name: 29; Conn30Name: 30; Conn31Name: 31; Conn32Name: 32; Conn33Name: 33; Conn34Name: 34; Conn35Name: 35; Conn36Name: 36; Conn37Name: 37; Conn38Name: 38; Conn39Name: 39; Conn40Name: 40; Conn08Name: 3.3V_D; Conn07Name: GND; Conn06Name: SWCLK; Conn05Name: SDIO; Alternative2: СНП346-8ВП22-2 РЮМК.430420.019ТУ; Name: СНП346-8ВП22-2-В; Value: 8; Group: Соединители; ViewControl: В, 10%; key: 44; SolderName: SNP346-8VP22-2; Mass: 0,00048; TemperatureRange: от минус 60 до 85; CardKRR: 75; VoltageLimit: 250; CurrentLimit: 1; X_SORT_1: 700; X_SORT_2: 600; X_SORT_3: 4; Conn04Name: SDIO; Conn03Name: SWCLK; Conn02Name: GND; Conn01Name: 3.3V_D; Alternative: PLD-8; MilitaryControl: ВП; MountType: РМ; Modify: 19.09.2018; Package: PLD; ComponentLink1Description: СНП346; ComponentLink1URL: \\192.168.0.101\U_Base\PDF\X\СНП346.pdf; HelpURL: \\192.168.0.101\U_Base\PDF\X\СНП346.pdf; DataSheet: #\\192.168.0.101\U_Base\PDF\X\СНП346.pdf#; PowerLimit: 250
XP8 = 2: PartNumber: Вилка СНП346-2ВП22-1-В; Manufacturer: АО «Карачевский завод Электродеталь»; ManufacturerTU: РЮМК.430420.011ТУ; Conn01Name: PDR_ON; Conn02Name: GND; Conn03Name: 3; Conn04Name: 4; Conn05Name: 5; Conn06Name: 6; Conn07Name: 7; Conn08Name: 8; Conn09Name: 9; Conn10Name: 10; Conn11Name: 11; Conn12Name: 12; Conn13Name: 13; Conn14Name: 14; Conn15Name: 15; Conn16Name: 16; Conn17Name: 17; Conn18Name: 18; Conn19Name: 19; Conn20Name: 20; Conn21Name: 21; Conn22Name: 22; Conn23Name: 23; Conn24Name: 24; Conn25Name: 25; Conn26Name: 26; Conn27Name: 27; Conn28Name: 28; Conn29Name: 29; Conn30Name: 30; Conn31Name: 31; Conn32Name: 32; Conn33Name: 33; Conn34Name: 34; Conn35Name: 35; Conn36Name: 36; Conn37Name: 37; Conn38Name: 38; Conn39Name: 39; Conn40Name: 40; Alternative2: СНП346-2ВП22-1 РЮМК.430420.019ТУ; Name: СНП346-2ВП22-1-В; Value: 2; Group: Соединители; ViewControl: В, 10%; SolderName: SNP346-2VP22-1; X_SORT_1: 700; X_SORT_2: 600; Mass: 0,00012; TemperatureRange: от минус 60 до 85; CardKRR: 75; VoltageLimit: 250; CurrentLimit: 1; Alternative: PLS-2; MilitaryControl: ВП; MountType: РМ; Modify: 19.09.2018; X_SORT_3: 4; Package: PLS; ComponentLink1Description: СНП346; ComponentLink1URL: \\192.168.0.253\U_Base\PDF\X\СНП346.pdf; HelpURL: \\192.168.0.253\U_Base\PDF\X\СНП346.pdf; DataSheet: #\\192.168.0.253\U_Base\PDF\X\СНП346.pdf#; PowerLimit: 250; key: 2
XP9 = 3: PartNumber: Вилка СНП346-3ВП22-1-В; Manufacturer: АО «Карачевский завод Электродеталь»; ManufacturerTU: РЮМК.430420.011ТУ; Conn03Name: GND; Conn02Name: USART1_RX; Conn01Name: USART1_TX; Conn04Name: 4; Conn05Name: 5; Conn06Name: 6; Conn07Name: 7; Conn08Name: 8; Conn09Name: 9; Conn10Name: 10; Conn11Name: 11; Conn12Name: 12; Conn13Name: 13; Conn14Name: 14; Conn15Name: 15; Conn16Name: 16; Conn17Name: 17; Conn18Name: 18; Conn19Name: 19; Conn20Name: 20; Conn21Name: 21; Conn22Name: 22; Conn23Name: 23; Conn24Name: 24; Conn25Name: 25; Conn26Name: 26; Conn27Name: 27; Conn28Name: 28; Conn29Name: 29; Conn30Name: 30; Conn31Name: 31; Conn32Name: 32; Conn33Name: 33; Conn34Name: 34; Conn35Name: 35; Conn36Name: 36; Conn37Name: 37; Conn38Name: 38; Conn39Name: 39; Conn40Name: 40; Alternative2: СНП346-3ВП22-1 РЮМК.430420.019ТУ; Name: СНП346-3ВП22-1-В; Value: 3; Group: Соединители; ViewControl: В, 10%; SolderName: SNP346-3VP22-1; X_SORT_1: 700; X_SORT_2: 600; Mass: 0,00018; TemperatureRange: от минус 60 до 85; CardKRR: 75; VoltageLimit: 250; CurrentLimit: 1; Alternative: PLS-3; MilitaryControl: ВП; MountType: РМ; Modify: 19.09.2018; X_SORT_3: 4; Package: PLS; ComponentLink1Description: СНП346; ComponentLink1URL: \\192.168.0.253\U_Base\PDF\X\СНП346.pdf; HelpURL: \\192.168.0.253\U_Base\PDF\X\СНП346.pdf; DataSheet: #\\192.168.0.253\U_Base\PDF\X\СНП346.pdf#; PowerLimit: 250; key: 3
XP10 = 4: PartNumber: Вилка СНП346-4ВП22-1-В; Manufacturer: АО «Карачевский завод Электродеталь»; ManufacturerTU: РЮМК.430420.011ТУ; Conn05Name: 5; Conn06Name: 6; Conn07Name: 7; Conn08Name: 8; Conn09Name: 9; Conn10Name: 10; Conn11Name: 11; Conn12Name: 12; Conn13Name: 13; Conn14Name: 14; Conn15Name: 15; Conn16Name: 16; Conn17Name: 17; Conn18Name: 18; Conn19Name: 19; Conn20Name: 20; Conn21Name: 21; Conn22Name: 22; Conn23Name: 23; Conn24Name: 24; Conn25Name: 25; Conn26Name: 26; Conn27Name: 27; Conn28Name: 28; Conn29Name: 29; Conn30Name: 30; Conn31Name: 31; Conn32Name: 32; Conn33Name: 33; Conn34Name: 34; Conn35Name: 35; Conn36Name: 36; Conn37Name: 37; Conn38Name: 38; Conn39Name: 39; Conn40Name: 40; Conn02Name: SWCLK; Conn03Name: SDIO; Conn04Name: GND; Conn01Name: 3.3V_D; Alternative2: СНП346-4ВП22-1 РЮМК.430420.019ТУ; Name: СНП346-4ВП22-1-В; Value: 4; Group: Соединители; ViewControl: В, 10%; SolderName: SNP346-4VP22-1; X_SORT_1: 700; X_SORT_2: 600; Mass: 0,00024; TemperatureRange: от минус 60 до 85; CardKRR: 75; VoltageLimit: 250; CurrentLimit: 1; Alternative: PLS-4; MilitaryControl: ВП; MountType: РМ; Modify: 19.09.2018; X_SORT_3: 4; Package: PLS; ComponentLink1Description: СНП346; ComponentLink1URL: \\192.168.0.253\U_Base\PDF\X\СНП346.pdf; HelpURL: \\192.168.0.253\U_Base\PDF\X\СНП346.pdf; DataSheet: #\\192.168.0.253\U_Base\PDF\X\СНП346.pdf#; PowerLimit: 250; key: 4
XP11 = 338: Manufacturer: АО «Карачевский завод Электродеталь»; ManufacturerTU: РЮМК.430420.011ТУ; PartNumber: Вилка СНП346-40ВП32-2-В; Conn01Name: SPI_MOSI_PCB+; Conn02Name: SPI_MOSI_PCB-; Conn03Name: SPI_MISO_PCB+; Conn04Name: SPI_MISO_PCB-; Conn05Name: SPI_CLK_PCB+; Conn06Name: SPI_CLK_PCB-; Conn07Name: SPI_SS_PCB+; Conn08Name: SPI_SS_PCB-; Conn09Name: UART6_RX; Conn10Name: UART6_TX; Conn11Name: Not_Used; Conn13Name: UIM_OUT1_PCB+; Conn14Name: UIM_OUT1_PCB-; Conn15Name: UIM_OUT1_PCB; Conn16Name: UIM_OUT2_PCB+; Conn17Name: UIM_OUT2_PCB-; Conn18Name: UIM_OUT2_PCB; Conn19Name: UIM_IN1_PCB; Conn20Name: UIM_IN2_PCB; Conn21Name: RS485_A_PCB; Conn22Name: RS485_B_PCB; Conn23Name: SVBP1_PCB; Conn24Name: SVBP2_PCB; Conn35Name: -5V_PCB; Conn36Name: +5V_PCB; Conn37Name: GND_PCB; Alternative2: СНП346-40ВП32-2 РЮМК.430420.019ТУ; Name: СНП346-40ВП32-2-В; Value: 40; Group: Соединители; ViewControl: В, 10%; key: 338; SolderName: SNP346-40VP32-2; Mass: 0,0024; TemperatureRange: от минус 60 до 85; CardKRR: 75; VoltageLimit: 250; CurrentLimit: 1; X_SORT_1: 700; X_SORT_2: 600; X_SORT_3: 4; Conn12Name: Not_Used; Conn25Name: Not_Used; Conn26Name: Not_Used; Conn27Name: Not_Used; Conn28Name: Not_Used; Conn29Name: Not_Used; Conn30Name: Not_Used; Conn31Name: Not_Used; Conn32Name: Not_Used; Conn33Name: Not_Used; Conn34Name: Not_Used; Conn38Name: GND_PCB; Conn39Name: +5V_PCB; Conn40Name: -5V_PCB; Alternative: PLD-40R; MilitaryControl: ВП; MountType: РМ; Modify: 22.01.2019; Package: PLD-R; ComponentLink1Description: СНП346; ComponentLink1URL: \\192.168.0.101\U_Base\PDF\X\СНП346.pdf; HelpURL: \\192.168.0.101\U_Base\PDF\X\СНП346.pdf; DataSheet: #\\192.168.0.101\U_Base\PDF\X\СНП346.pdf#; PowerLimit: 250
XP12 = 338: Manufacturer: АО «Карачевский завод Электродеталь»; ManufacturerTU: РЮМК.430420.011ТУ; PartNumber: Вилка СНП346-40ВП32-2-В; Conn01Name: VOLT1_PCB; Conn02Name: VOLT2_PCB; Conn03Name: VOLT3_PCB; Conn04Name: VOLT4_PCB; Conn05Name: VOLT5_PCB; Conn06Name: VOLT6_PCB; Conn07Name: VOLT7_PCB; Conn08Name: VOLT8_PCB; Conn09Name: TRM_SDA_PCB; Conn10Name: TRM_SCL_PCB; Conn11Name: ADDR1_PCB; Conn12Name: ADDR2_PCB; Conn13Name: ADDR3_PCB; Conn14Name: ADDR4_PCB; Conn15Name: ADDR5_PCB; Conn16Name: ADDR6_PCB; Conn17Name: LED1_PCB; Conn18Name: LED2_PCB; Conn19Name: LED3_PCB; Conn20Name: LED4_PCB; Conn21Name: LED5_PCB; Conn22Name: LED6_PCB; Conn23Name: SR_DS_PCB; Conn24Name: SR_STCP_PCB; Conn25Name: SR_SHCP_PCB; Conn26Name: INT1_PCB; Conn27Name: INT2_PCB; Conn28Name: INT3_PCB; Conn29Name: INT4_PCB; Conn30Name: INT5_PCB; Conn31Name: INT6_PCB; Conn32Name: INT7_PCB; Conn33Name: INT8_PCB; Conn34Name: Not_Used; Alternative2: СНП346-40ВП32-2 РЮМК.430420.019ТУ; Name: СНП346-40ВП32-2-В; Value: 40; Group: Соединители; ViewControl: В, 10%; key: 338; SolderName: SNP346-40VP32-2; Mass: 0,0024; TemperatureRange: от минус 60 до 85; CardKRR: 75; VoltageLimit: 250; CurrentLimit: 1; X_SORT_1: 700; X_SORT_2: 600; X_SORT_3: 4; Conn35Name: Not_Used; Conn36Name: Not_Used; Conn37Name: Not_Used; Conn38Name: Not_Used; Conn39Name: Not_Used; Conn40Name: Not_Used; Alternative: PLD-40R; MilitaryControl: ВП; MountType: РМ; Modify: 22.01.2019; Package: PLD-R; ComponentLink1Description: СНП346; ComponentLink1URL: \\192.168.0.101\U_Base\PDF\X\СНП346.pdf; HelpURL: \\192.168.0.101\U_Base\PDF\X\СНП346.pdf; DataSheet: #\\192.168.0.101\U_Base\PDF\X\СНП346.pdf#; PowerLimit: 250
XS1 = 120: Manufacturer: АО «Карачевский завод Электродеталь»; ManufacturerTU: РЮМК.430420.011ТУ; PartNumber: Розетка СНП346-40РП22-2-В; Conn01Name: GND_IN; Conn02Name: +48V_IN; Conn09Name: GND; Conn10Name: +5V_D; Conn14Name: -5V_D; Conn18Name: +3.3V_D; Conn21Name: GNDA; Conn22Name: +5V_A; Conn26Name: -5V_A; Conn30Name: +3.3V_A; Conn33Name: GND_PCB; Conn34Name: +5V_PCB; Conn38Name: -5V_PCB; Alternative2: СНП346-40РП22-2 РЮМК.430420.019ТУ; Name: СНП346-40РП22-2-В; Value: 40; Group: Соединители; ViewControl: В, 10%; key: 120; SolderName: SNP346-40RP22-2; Mass: 0,0036; TemperatureRange: от минус 60 до 85; CardKRR: 75; VoltageLimit: 250; CurrentLimit: 1; X_SORT_1: 700; X_SORT_2: 600; X_SORT_3: 4; Conn03Name: +48V_IN; Conn04Name: GND_IN; Conn05Name: GND_IN; Conn06Name: +48V_IN; Conn07Name: +48V_IN; Conn08Name: GND_IN; Conn11Name: +5V_D; Conn12Name: GND; Conn13Name: GND; Conn15Name: -5V_D; Conn16Name: GND; Conn17Name: GND; Conn19Name: +3.3V_D; Conn20Name: GND; Conn23Name: +5V_A; Conn24Name: GNDA; Conn25Name: GNDA; Conn27Name: -5V_A; Conn28Name: GNDA; Conn29Name: GNDA; Conn31Name: +3.3V_A; Conn32Name: GNDA; Conn35Name: +5V_PCB; Conn36Name: GND_PCB; Conn37Name: GND_PCB; Conn39Name: -5V_PCB; Conn40Name: GND_PCB; Alternative: PBD-40; MilitaryControl: ВП; MountType: РМ; Modify: 19.09.2018; Package: PBD; ComponentLink1Description: СНП346; ComponentLink1URL: \\192.168.0.101\U_Base\PDF\X\СНП346.pdf; HelpURL: \\192.168.0.101\U_Base\PDF\X\СНП346.pdf; DataSheet: #\\192.168.0.101\U_Base\PDF\X\СНП346.pdf#; PowerLimit: 250
XS2 = 120: Manufacturer: АО «Карачевский завод Электродеталь»; ManufacturerTU: РЮМК.430420.011ТУ; PartNumber: Розетка СНП346-40РП22-2-В; Conn01Name: VOLT1_EN; Conn02Name: VOLT1_UIM; Conn03Name: VOLT2_UIM; Conn04Name: VOLT1_PCB; Conn05Name: VOLT2_PCB; Conn06Name: VOLT2_EN; Conn07Name: VOLT3_EN; Conn08Name: VOLT3_UIM; Conn09Name: VOLT4_UIM; Conn10Name: VOLT3_PCB; Conn11Name: VOLT4_PCB; Conn12Name: VOLT4_EN; Conn13Name: VOLT5_EN; Conn14Name: VOLT5_UIM; Conn15Name: VOLT6_UIM; Conn16Name: VOLT5_PCB; Conn17Name: VOLT6_PCB; Conn18Name: VOLT6_EN; Conn19Name: VOLT7_EN; Conn20Name: VOLT7_UIM; Conn21Name: VOLT8_UIM; Conn22Name: VOLT7_PCB; Conn23Name: VOLT8_PCB; Conn24Name: VOLT8_EN; Conn25Name: Not_Used; Conn33Name: DS_MISO; Conn34Name: DS_MOSI; Conn35Name: STCP_CS1; Conn36Name: SHCP_CLK; Conn37Name: OTG_FS_DP; Conn38Name: STCP_CS2; Conn39Name: OTG_FS_ID; Conn40Name: OTG_FS_DM; Alternative2: СНП346-40РП22-2 РЮМК.430420.019ТУ; Name: СНП346-40РП22-2-В; Value: 40; Group: Соединители; ViewControl: В, 10%; key: 120; SolderName: SNP346-40RP22-2; Mass: 0,0036; TemperatureRange: от минус 60 до 85; CardKRR: 75; VoltageLimit: 250; CurrentLimit: 1; X_SORT_1: 700; X_SORT_2: 600; X_SORT_3: 4; Conn26Name: Not_Used; Conn27Name: Not_Used; Conn28Name: Not_Used; Conn29Name: Not_Used; Conn30Name: Not_Used; Conn31Name: Not_Used; Conn32Name: Not_Used; Alternative: PBD-40; MilitaryControl: ВП; MountType: РМ; Modify: 19.09.2018; Package: PBD; ComponentLink1Description: СНП346; ComponentLink1URL: \\192.168.0.101\U_Base\PDF\X\СНП346.pdf; HelpURL: \\192.168.0.101\U_Base\PDF\X\СНП346.pdf; DataSheet: #\\192.168.0.101\U_Base\PDF\X\СНП346.pdf#; PowerLimit: 250
ZQ1 = 9: Manufacturer: ОАО «Пьезо»; ManufacturerTU: ТУ6321-006-07604008-04; PartNumber: Резонатор кварцевый РК456МДУ-6ДТ-8M-20 пФ-В; Alternative: HC49-SМ 8,000 МГц; Name: РК456МДУ-6ДТ-8M; Group: Резонатор кварцевый; ViewControl: В,100%; Key: 9; SolderName: RK456MDU-6DT; Mark: 8.000; TemperatureRange: от минус 60 до 85; CardKRR: 69; PowerLimit: 0,002; X_SORT_1: 800; X_SORT_3: 4; MilitaryControl: ВП; MountType: РМ; Modify: 14.03.2019; Package: HC49; ComponentLink1URL: \\192.168.0.253\U_Base\PDF\OTHER\РК456МДУ.pdf; HelpURL: \\192.168.0.253\U_Base\PDF\OTHER\РК456МДУ.pdf; DataSheet: #\\192.168.0.253\U_Base\PDF\OTHER\РК456МДУ.pdf#; X_SORT_2: 800